# EasyEDA Pro project MSDRV3.eprj, schematic Schematic3
Create Date: 2024-11-12; Page Name: P1; Project Name: MSDRV3; Schematic Name: Schematic3; Update Date: 2024-11-12; Company: EasyEDA.com; Drawn: EasyEDA; Page Size: A4; Part Number: JLCPCB-002; Reviewed: EasyEDA; Version: V0.1
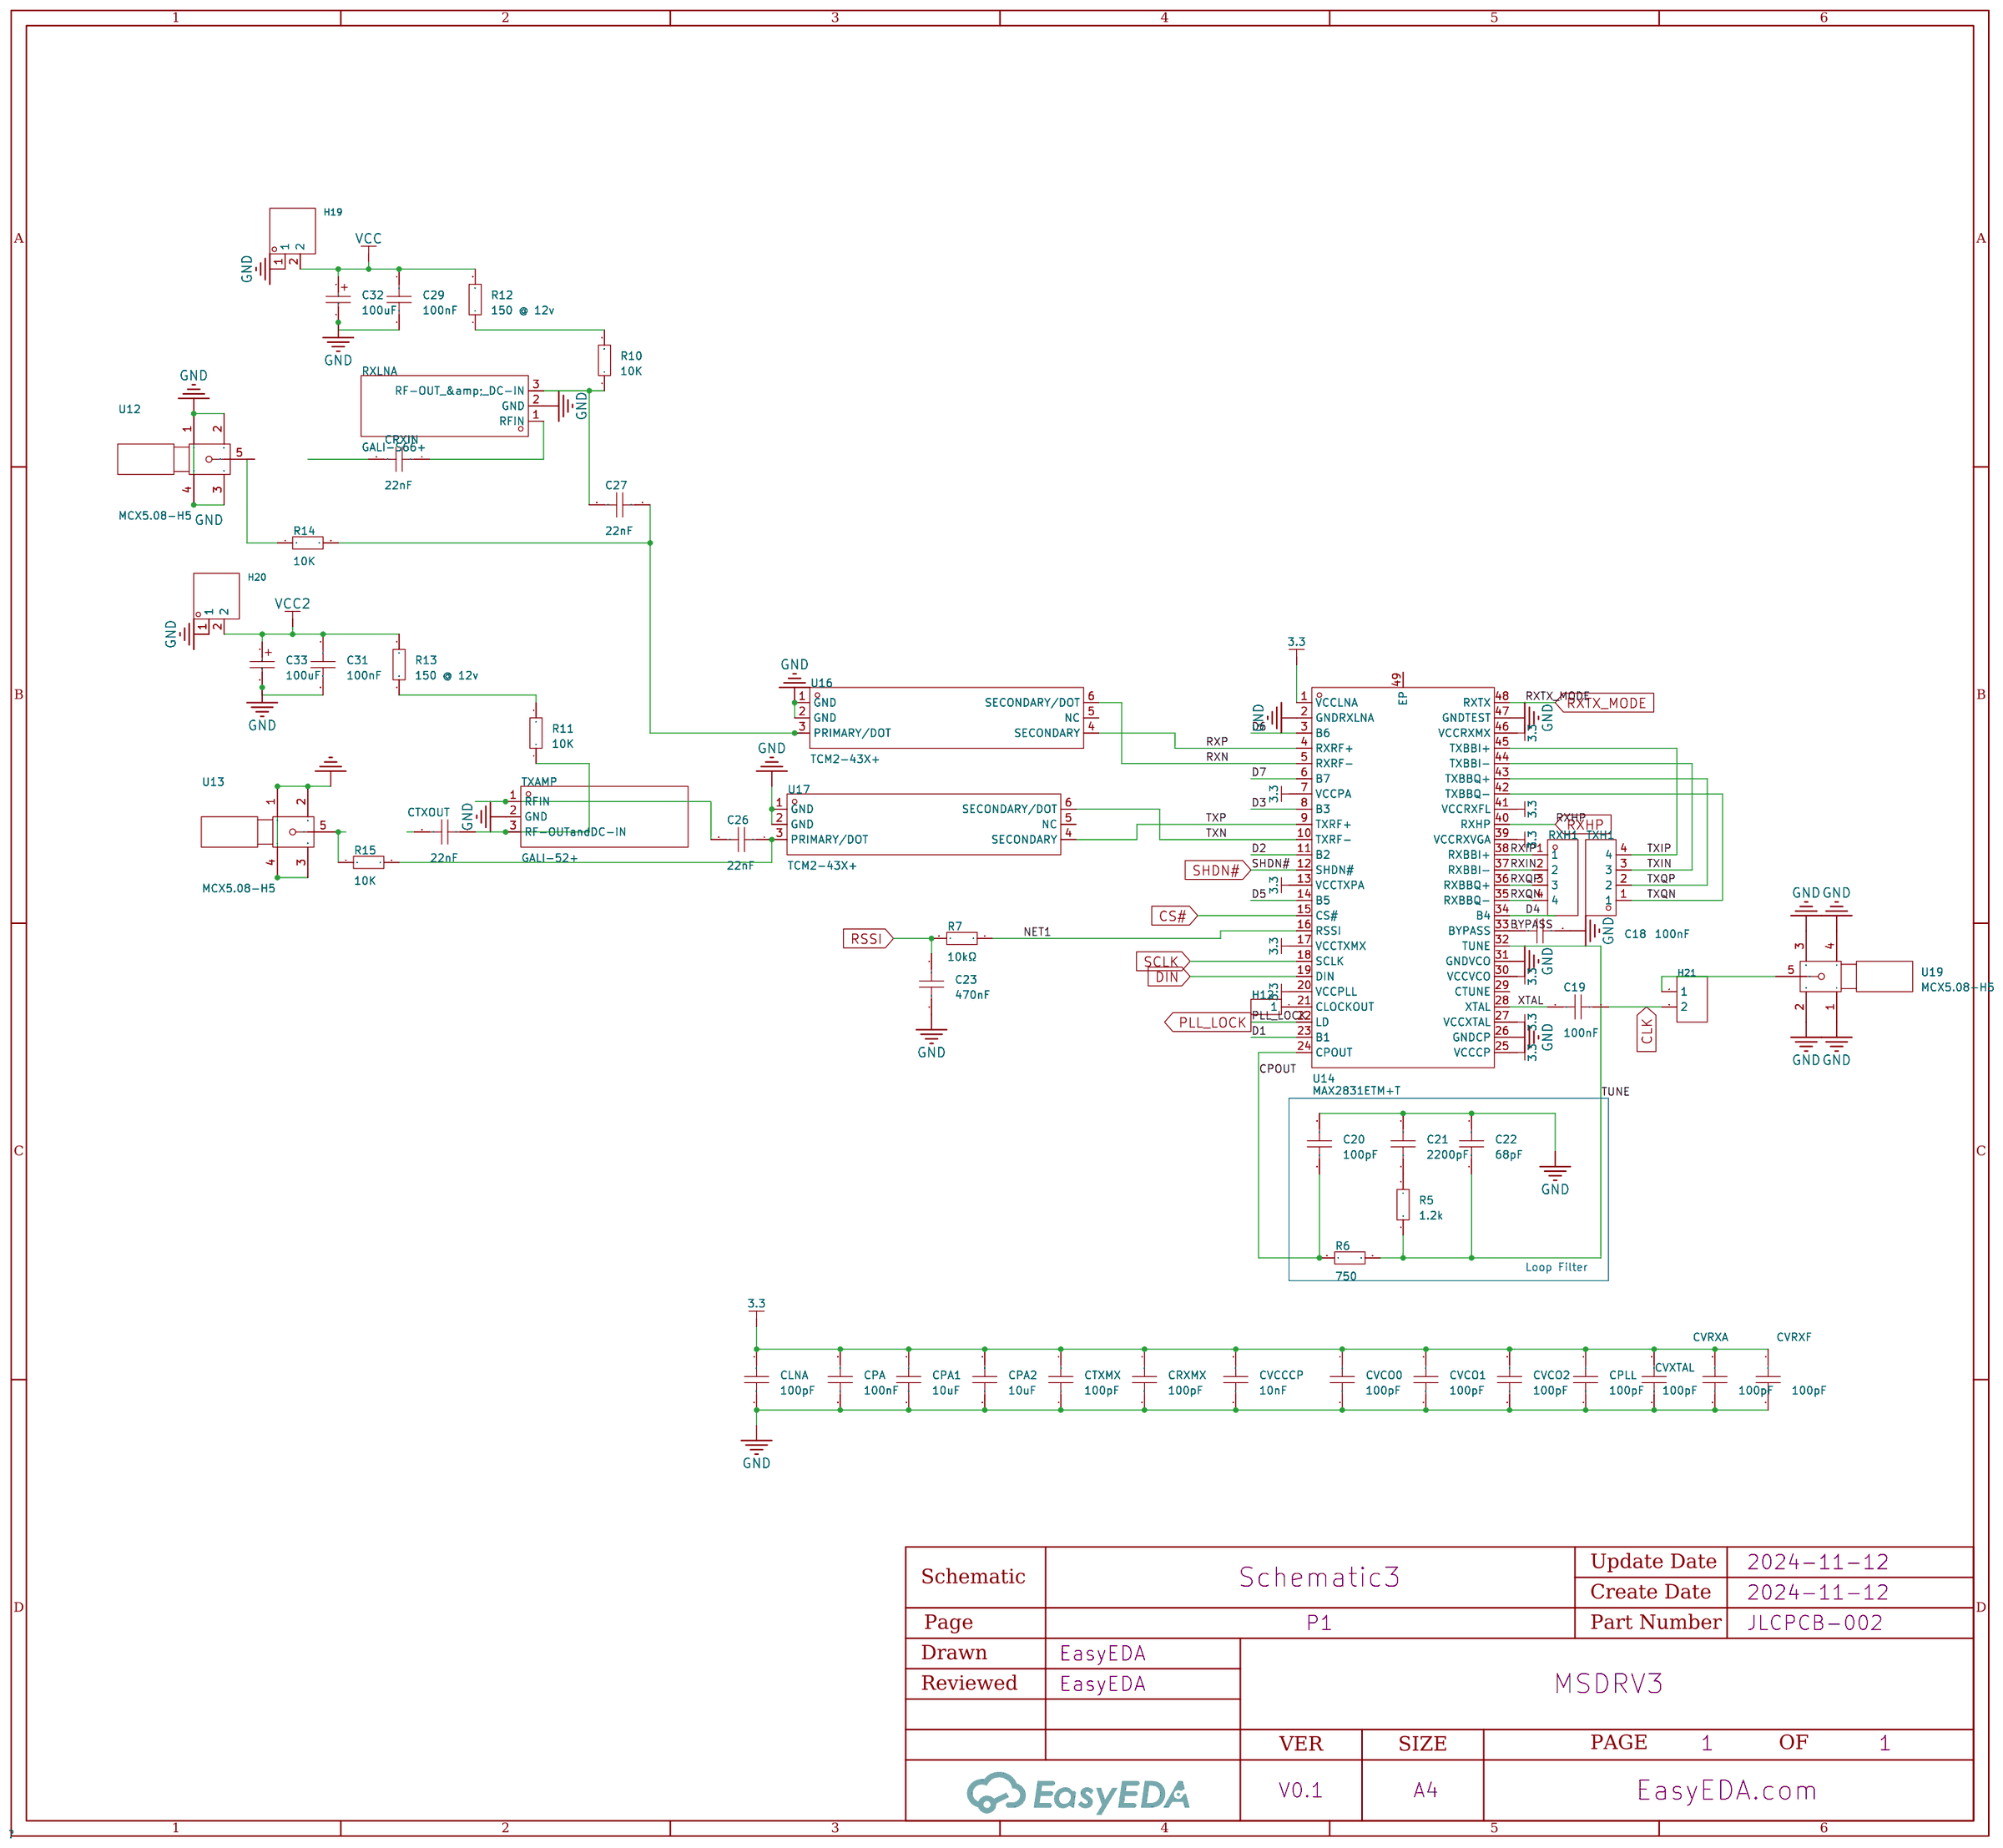
[diagram p1: schematic sheet]

## Parts
C18  100nF  [C0603]
C19  100nF  [C0603]
C20  100pF  [C0603]
C21  2200pF  [C0603]
C22  68pF  [C0603]
C23  470nF  [CAP-TH_L7.2-W2.5-P5.00-D0.5]
C26  22nF  [C0805]
C27  22nF  [C0805]
C29  100nF  [C0805]
C31  100nF  [C0805]
C32  100uF  [CAP-SMD_BD3.0-L3.3-W3.3-RD]
C33  100uF  [CAP-SMD_BD3.0-L3.3-W3.3-RD]
CLNA  100pF  [C0603]
CPA  100nF  [C0603]
CPA1  10uF  [C0603]
CPA2  10uF  [C0603]
CPLL  100pF  [C0603]
CRXIN  22nF  [C0805]
CRXMX  100pF  [C0603]
CTXMX  100pF  [C0603]
CTXOUT  22nF  [C0805]
CVCCCP  10nF  [C0603]
CVCO0  100pF  [C0603]
CVCO1  100pF  [C0603]
CVCO2  100pF  [C0603]
CVRXA  100pF  [C0603]
CVRXF  100pF  [C0603]
CVXTAL  100pF  [C0603]
H12  -  [HDR-TH_1P-V-M_XKB_X4611WV-01I-C28D40]
H19  -  [HDR-TH_2P-P2.54-V-M-1]
H20  -  [HDR-TH_2P-P2.54-V-M-1]
H21  -  [HDR-TH_2P-P2.54-V-F]
R5  1.2k  [R0603]
R6  750  [R0603]
R7  10kΩ  [RES-TH_BD1.8-L3.2-P7.20-D0.4]
R10  10K  [R0603]
R11  10K  [R0603]
R12  150 @ 12v  [R0603]
R13  150 @ 12v  [R0603]
R14  10K  [R0201]
R15  10K  [R0201]
RXH1  -  [HDR-TH_4P-P2.54-V-M]
RXLNA  GALI-S66+  [SOT-89-3_L4.5-W2.5-P1.50-LS4.2-BR]
TXAMP  GALI-52+  [SOT-89-3_L4.5-W2.5-P1.50-LS4.2-BR]
TXH1  -  [HDR-TH_4P-P2.54-V-M]
U12  MCX5.08-H5  [SMA-TH_MCX5.08-H5]
U13  MCX5.08-H5  [SMA-TH_MCX5.08-H5]
U14  MAX2831ETM+T  [TQFN-48_L7.0-W7.0-P0.50-TL-EP5.6]
U16  TCM2-43X+  [IND-SMD_6P-L4.1-W3.8-P1.27-TL]
U17  TCM2-43X+  [IND-SMD_6P-L4.1-W3.8-P1.27-TL]
U19  MCX5.08-H5  [SMA-TH_MCX5.08-H5]

## Library data of the parts
C18-C22 CLNA CPA CPA1 CPA2 CPLL CRXMX CTXMX CVCCCP CVCO0-CVCO2 CVRXA CVRXF CVXTAL = CAP_0603: Supplier Footprint: 0603
C23 = C241J474J20C000: Capacitance:470nF Tolerance:±5% Tolerance:±5% Voltage Rated: Dielectric Material:Metallized Polyester Film Capacitor Operating Temperature:-55℃~+125℃ Operating Temperature:-55℃~+125℃; LCSC Part Name: 470nF ±5% 63V; Supplier Part: C5121927; Manufacturer: faratronic(厦门法拉); Supplier Footprint: 插件,P=5mm; JLCPCB Part Class: Extended Part; Datasheet: https://atta.szlcsc.com/upload/public/pdf/source/20220309/53E9D6585E584592026F1B9FCED89B93.pdf; Supplier: LCSC; Tolerance: ±5%; Dielectric Material: Metallized Polyester Film Capacitor; Operating Temperature: -55℃~+125℃
C26 C27 C29 C31 CRXIN CTXOUT = CAP_0805: Supplier Footprint: 0805
C32 C33 = C_Ele_SMD_3x5.4mm: Supplier Footprint: SMD,3x5.4mm
H12 = HDR-M_2.54_1x1P: Supplier Footprint: Through
H19 H20 = HDR-M_2.54_1x2P: Supplier Footprint: Through
H21 = HDR-F_2.54_1x2P: Supplier Footprint: Through
R5 R6 R10-R13 = Res_0603: Supplier Footprint: 0603
R7 = Res_AXIAL-1/8W: Supplier Footprint: Through
R14 R15 = Res_0201: Supplier Footprint: 0201
RXH1 TXH1 = HDR-M_2.54_1x4P: Supplier Footprint: Through
RXLNA = GALI-S66+: Applications:Mobile Phone；PCS Frequency Range:0Hz~3GHz Frequency Range:0Hz~3GHz Gain:16.4dB Noise Figure:2.4dB Supply Voltage:3V~4V Supply Voltage:3V~4V Supply Current:16mA; Supplier Part: C3193274; Manufacturer: Mini-Circuits; Supplier Footprint: SOT-89; JLCPCB Part Class: Extended Part; Supplier: LCSC; Applications: Mobile Phone；PCS; Frequency Range: 0Hz~3GHz; Gain: 16.4dB; Noise Figure: 2.4dB; Supply Voltage: 3V~4V; Supply Current: 16mA
TXAMP = GALI-52+: Applications:Cellular,PCS Frequency Range:0Hz~2GHz Frequency Range:0Hz~2GHz Gain:14.4dB Noise Figure:2.7dB Supply Voltage:4V~4.8V Supply Voltage:4V~4.8V Supply Current:50mA; Supplier Part: C2683445; Manufacturer: Mini-Circuits; Supplier Footprint: SOT-89-3; JLCPCB Part Class: Extended Part; Datasheet: https://atta.szlcsc.com/upload/public/pdf/source/20210107/C2683445_4C019D776B336260B8EA539DE99FD577.pdf; Supplier: LCSC; Applications: Cellular,PCS; Frequency Range: 0Hz~2GHz; Gain: 14.4dB; Noise Figure: 2.7dB; Supply Voltage: 4V~4.8V; Supply Current: 50mA
U12 U13 U19 = MCX5.08-H5_C9900009324: Supplier Part: C9900009324; Supplier Footprint: COAX-F; JLCPCB Part Class: Extended Part; Supplier: LCSC
U14 = MAX2831ETM+T: Frequency Range:2.4GHz Frequency Range:2.4GHz Interface:SPI Operating Voltage:2.7V~3.6V Operating Voltage:2.7V~3.6V Applications:WiFi Output Power:21dBm Data Rate:54Mbps Current Of Transmitting:82mA Sensitivity:-76dBm Receive Current:62mA Operating Temper; Supplier Part: C2152047; Manufacturer: ADI(亚德诺)/MAXIM(美信); Supplier Footprint: TQFN-48-EP(7x7); JLCPCB Part Class: Extended Part; Datasheet: https://atta.szlcsc.com/upload/public/pdf/source/20210601/D5E13A4F591163B65DE03F91E5182685.pdf; Supplier: LCSC; Frequency Range: 2.4GHz; Interface: SPI; Operating Voltage: 2.7V~3.6V; Applications: WiFi; Output Power: 21dBm; Data Rate: 54Mbps; Current Of Transmitting: 82mA; Sensitivity: -76dBm; Receive Current: 62mA; Operating Temperature: -40℃~+85℃
U16 U17 = TCM2-43X+: Frequency Range:10MHz~4GHz Frequency Range:10MHz~4GHz Impedance Ratio-Unbalanced/Balanced:1:2 Insertion Loss (Max):3dB Phase Balance:7° Return Loss (Min):14.98dB; LCSC Part Name: 射频变压器; Supplier Part: C2885644; Manufacturer: Mini-Circuits; Supplier Footprint: SMD-6P; JLCPCB Part Class: Extended Part; Datasheet: https://atta.szlcsc.com/upload/public/pdf/source/20210825/C2885644_24D8D5254C12C7AF6CFE8387515C0B6D.pdf; Supplier: LCSC; Frequency Range: 10MHz~4GHz; Impedance Ratio-Unbalanced/Balanced: 1:2; Insertion Loss (Max): 3dB; Phase Balance: 7°; Return Loss (Min): 14.98dB

## Nets
GND: C18.1 C20.1 C21.1 C22.1 C23.1 C29.2 C31.2 C32.2 C33.2 CLNA.2 CPA.2 CPA1.2 CPA2.2 CPLL.2 CRXMX.2 CTXMX.2 CVCCCP.2 CVCO0.2 CVCO1.2 CVCO2.2 CVRXA.2 CVRXF.2 CVXTAL.2 H19.1 H20.1 RXLNA.2(GND) TXAMP.2(GND) U12.1 U12.2 U12.3 U12.4 U13.1 U13.2 U13.3 U13.4 U14.2(GNDRXLNA) U14.26(GNDCP) U14.31(GNDVCO) U14.47(GNDTEST) U16.1(GND) U16.2(GND) U17.1(GND) U17.2(GND) U19.1 U19.2 U19.3 U19.4
VCC: C29.1 C32.1 H19.2 R12.2
VCC2: C31.1 C33.1 H20.2 R13.2
3.3: CLNA.1 CPA.1 CPA1.1 CPA2.1 CPLL.1 CRXMX.1 CTXMX.1 CVCCCP.1 CVCO0.1 CVCO1.1 CVCO2.1 CVRXA.1 CVRXF.1 CVXTAL.1 U14.1(VCCLNA) U14.7(VCCPA) U14.13(VCCTXPA) U14.17(VCCTXMX) U14.20(VCCPLL) U14.25(VCCCP) U14.27(VCCXTAL) U14.30(VCCVCO) U14.39(VCCRXVGA) U14.41(VCCRXFL) U14.46(VCCRXMX)
BYPASS: C18.2 U14.33(BYPASS)
CLK: C19.1 H21.2
CPOUT: C20.2 R6.1 U14.24(CPOUT)
CS#: U14.15(CS#)
D1: U14.23(B1)
D2: U14.11(B2)
D3: U14.8(B3)
D4: U14.34(B4)
D5: U14.14(B5)
D6: U14.3(B6)
D7: U14.6(B7)
DIN: U14.19(DIN)
NET1: R7.1 U14.16(RSSI)
PLL_LOCK: U14.22(LD)
RSSI: C23.2 R7.2
RXHP: U14.40(RXHP)
RXIN: RXH1.2 U14.37(RXBBI-)
RXIP: RXH1.1 U14.38(RXBBI+)
RXN: U14.5(RXRF-) U16.6(SECONDARY/DOT)
RXP: U14.4(RXRF+) U16.4(SECONDARY)
RXQN: RXH1.4 U14.35(RXBBQ-)
RXQP: RXH1.3 U14.36(RXBBQ+)
RXTX_MODE: U14.48(RXTX)
SCLK: U14.18(SCLK)
SHDN#: U14.12(SHDN#)
TUNE: C22.2 R5.2 R6.2 U14.32(TUNE)
TXIN: TXH1.3 U14.44(TXBBI-)
TXIP: TXH1.4 U14.45(TXBBI+)
TXN: U14.10(TXRF-) U17.6(SECONDARY/DOT)
TXP: U14.9(TXRF+) U17.4(SECONDARY)
TXQN: TXH1.1 U14.42(TXBBQ-)
TXQP: TXH1.2 U14.43(TXBBQ+)
XTAL: C19.2 U14.28(XTAL)
$1N1511: H12.1 U14.21(CLOCKOUT)
$1N3367: C21.2 R5.1
$1N12697: C26.1 R15.2 U17.3(PRIMARY/DOT)
$1N12710: C26.2 TXAMP.1(RFIN)
$1N12721: CTXOUT.1 R11.1 TXAMP.3(RF-OUTandDC-IN)
$1N12761: C27.1 R14.2 U16.3(PRIMARY/DOT)
$1N12820: R10.2 R12.1
$1N12851: R11.2 R13.1
$1N13115: C27.2 R10.1 RXLNA.3(RF-OUT &amp; DC-IN)
$1N13128: CRXIN.1 RXLNA.1(RFIN)
$1N19235: H21.1 U19.5
Net-(R14-1): R14.1 U12.5
Net-(R15-1): R15.1 U13.5

Not connected (* = marked no-connect by the designer): CRXIN 2; CTXOUT 2; U14 29(CTUNE) 49(EP); U16 5(NC); U17 5(NC)

## Notes on the sheet
- Loop Filter
